# EasyEDA Pro project hardware.eprj, schematic Schematic5
Create Date: 2022-12-18; Page Name: P1; Project Name: hardware; Schematic Name: Schematic5; Update Date: 2022-12-24; Company: 嘉立创EDA; Page Size: A4; Version: V1.0
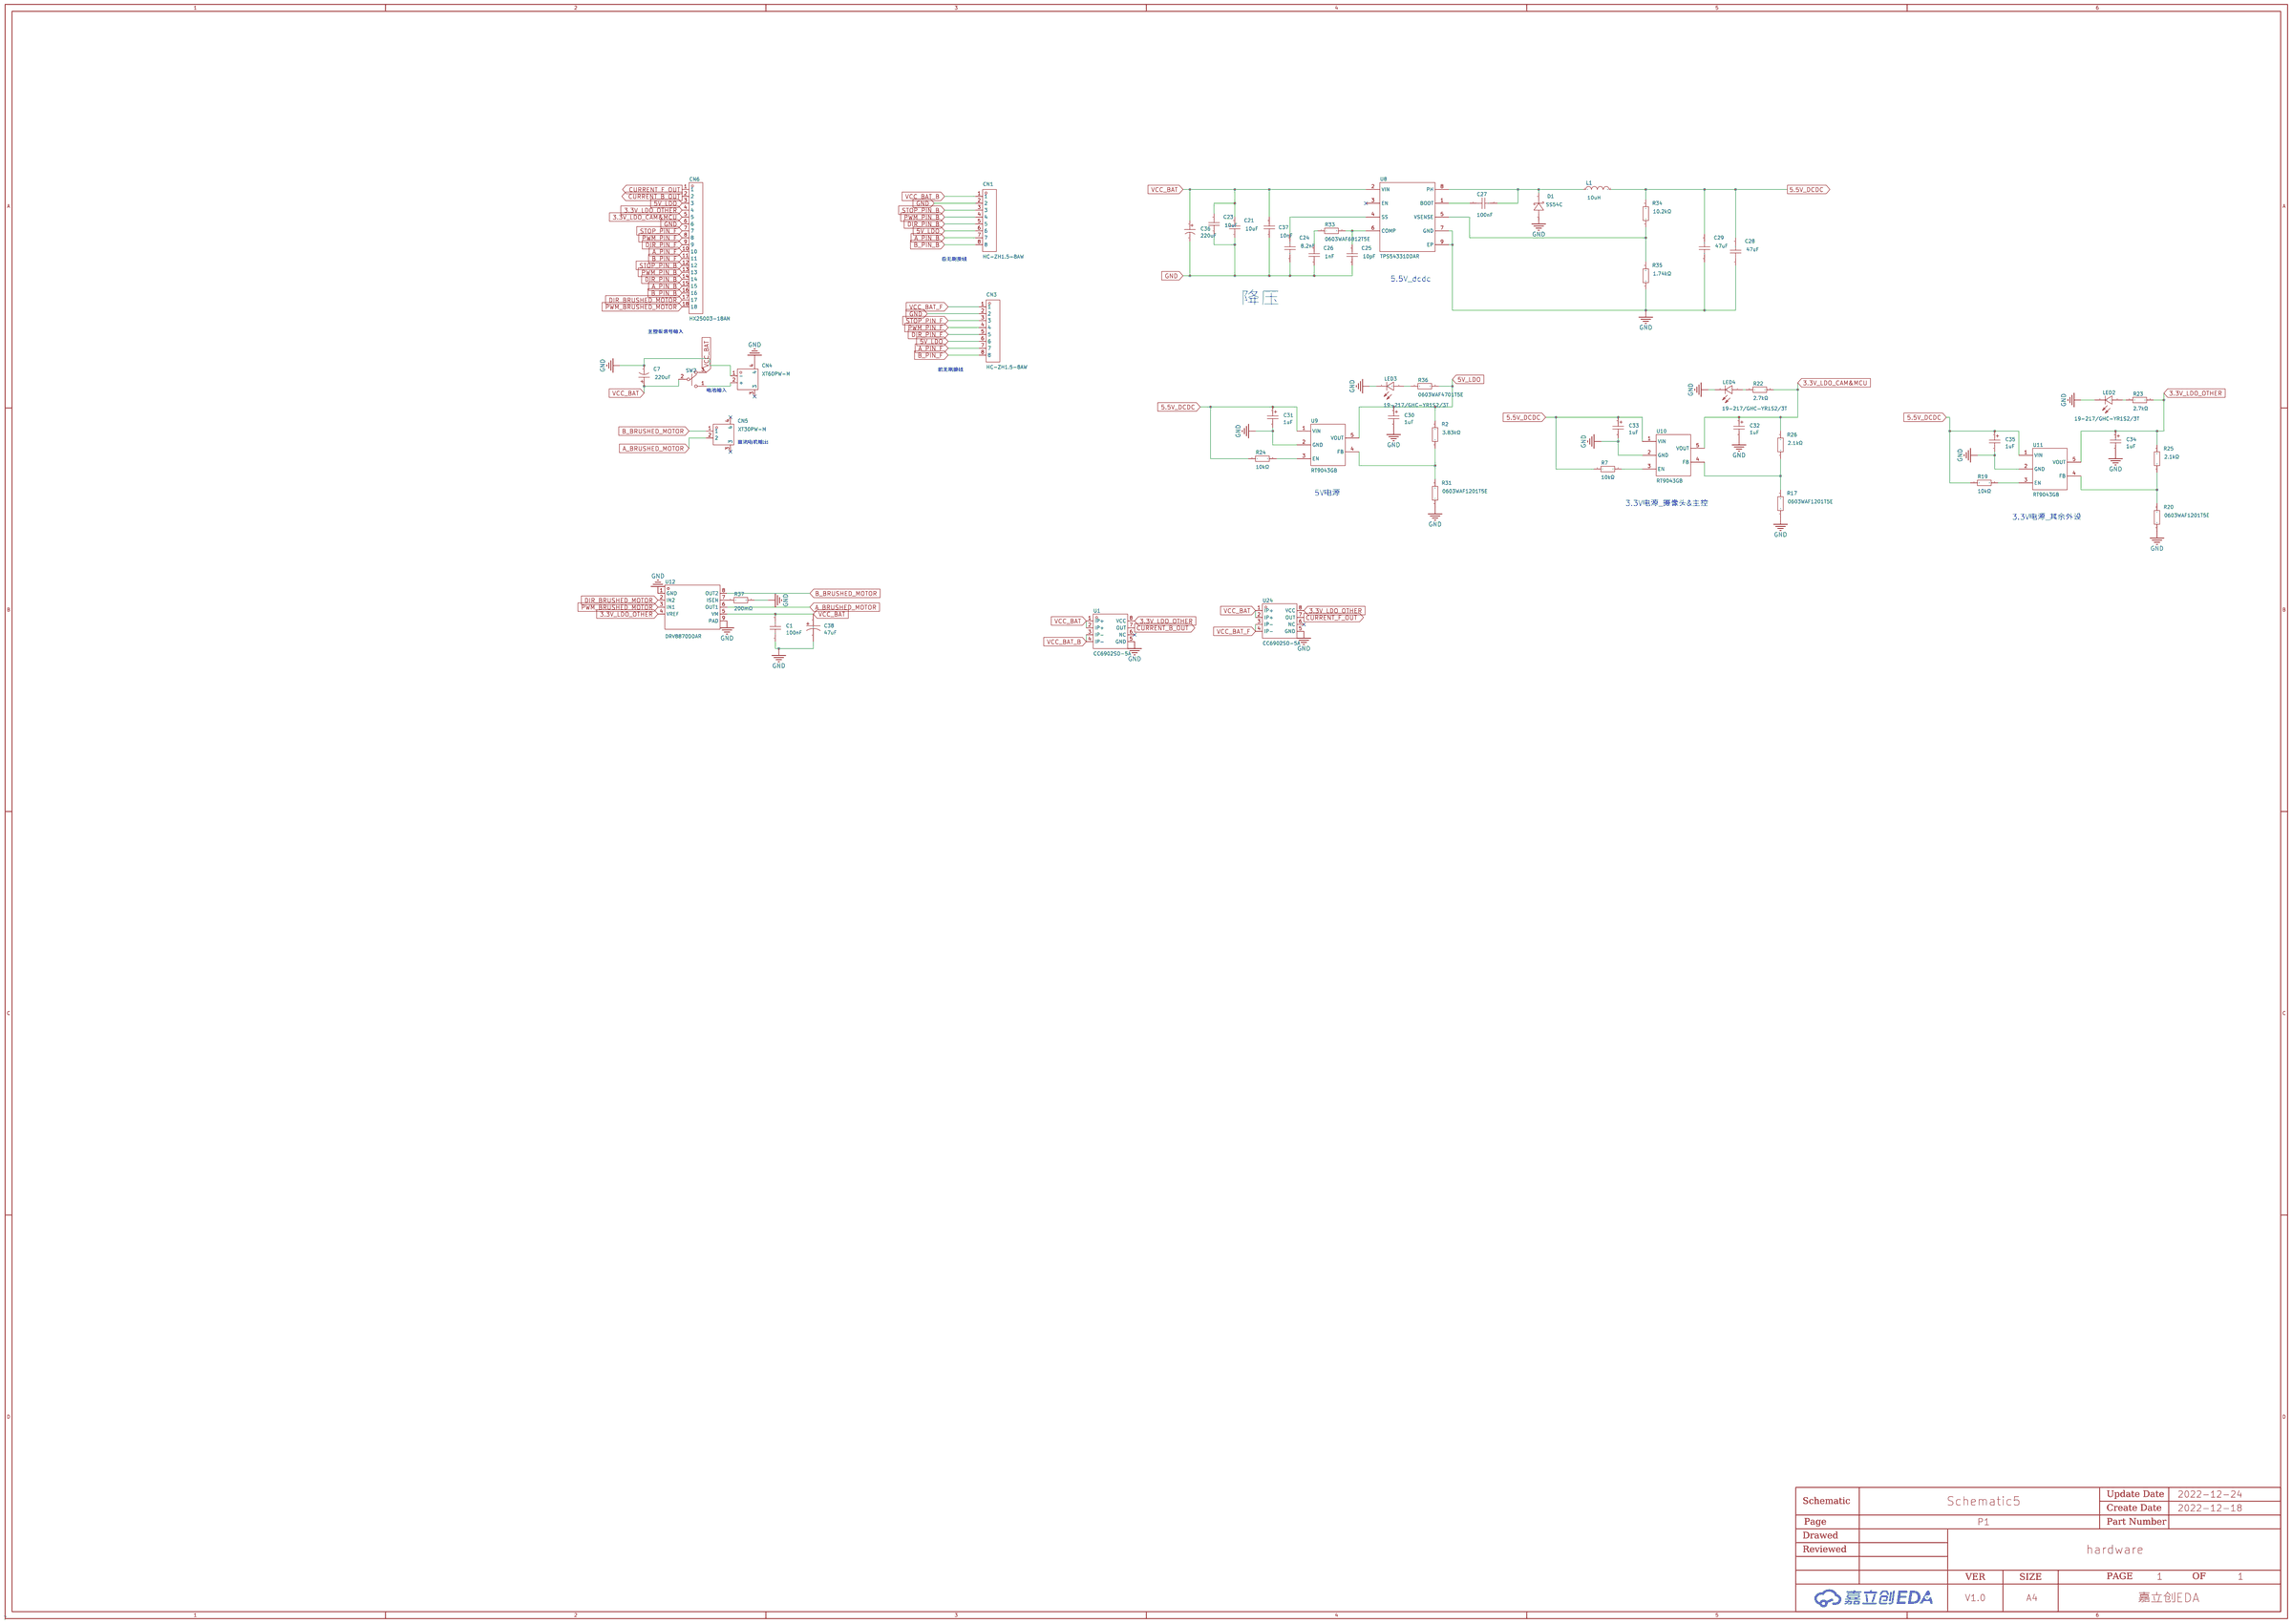
[diagram p5: schematic sheet]

## Parts
C1  100nF  [C0603]
C7  220uF  [CAP-TH_BD10.0-P5.00-D1.0-FD]
C21  10uF  [C1206]
C23  10uF  [C1206]
C24  8.2nF  [C0603]
C25  10pF  [C0402]
C26  1nF  [C0603]
C27  100nF  [C0603]
C28  47uF  [C1206]
C29  47uF  [C1206]
C30  1uF  [CAP-SMD_L3.2-W1.6-RD]
C31  1uF  [CAP-SMD_L3.2-W1.6-RD]
C32  1uF  [CAP-SMD_L3.2-W1.6-RD]
C33  1uF  [CAP-SMD_L3.2-W1.6-RD]
C34  1uF  [CAP-SMD_L3.2-W1.6-RD]
C35  1uF  [CAP-SMD_L3.2-W1.6-RD]
C36  220uF  [CAP-TH_BD10.0-P5.00-D1.0-FD]
C37  10nF  [C0603]
C38  47uF  [CAP-TH_BD6.3-P2.50-D1.0-FD]
CN1  HC-ZH1.5-8AW  [CONN-TH_8P-P1.50_HCTL_HC-ZH1.5-8AW]
CN3  HC-ZH1.5-8AW  [CONN-TH_8P-P1.50_HCTL_HC-ZH1.5-8AW]
CN4  XT60PW-M  [CONN-TH_XT60PW-M]
CN5  XT30PW-M  [CONN-TH_XT30PW-M]
CN6  HX25003-18AN  [CONN-TH_HX25003-18AN]
D1  SS54C  [SMC_L6.9-W5.9-LS7.9-R-RD]
L1  10uH  [IND-SMD_L11.5-W10.0_SMMS1040]
LED2  19-217/GHC-YR1S2/3T  [LED0603-R-RD]
LED3  19-217/GHC-YR1S2/3T  [LED0603-R-RD]
LED4  19-217/GHC-YR1S2/3T  [LED0603-R-RD]
R2  3.83kΩ  [R0603]
R7  10kΩ  [R0603]
R17  0603WAF1201T5E  [R0603]
R19  10kΩ  [R0603]
R20  0603WAF1201T5E  [R0603]
R22  2.7kΩ  [R0603]
R23  2.7kΩ  [R0603]
R24  10kΩ  [R0603]
R25  2.1kΩ  [R0603]
R26  2.1kΩ  [R0603]
R31  0603WAF1201T5E  [R0603]
R33  0603WAF6812T5E  [R0603]
R34  10.2kΩ  [R0603]
R35  1.74kΩ  [R0603]
R36  0603WAF4701T5E  [R0603]
R37  200mΩ  [R2512]
SW2  MT-0-103-A101-M200-RS+PJ  [SW-TH_MT-0-103-A101-M200-RS]
U1  CC6902SO-5A  [SOP-8_L4.9-W3.9-P1.27-LS6.0-BL]
U8  TPS54331DDAR  [SOIC-8_L5.0-W4.0-P1.27-LS6.0-BL-EP2.0]
U9  RT9043GB  [SOT-23-5_L3.0-W1.7-P0.95-LS2.8-BR]
U10  RT9043GB  [SOT-23-5_L3.0-W1.7-P0.95-LS2.8-BR]
U11  RT9043GB  [SOT-23-5_L3.0-W1.7-P0.95-LS2.8-BR]
U12  DRV8870DDAR  [HSOP-8_L5.0-W4.0-P1.27-LS6.2-BL-EP]
U24  CC6902SO-5A  [SOP-8_L4.9-W3.9-P1.27-LS6.0-BL]

## Library data of the parts
C1 C27 = CC0603KRX7R9BB104: 容值:100nF;精度:±10%;额定电压:50V;材质(温度系数):X7R;; LCSC Part Name: 100nF ±10% 50V; Supplier Part: C14663; Manufacturer: YAGEO(国巨); Supplier Footprint: 0603; JLCPCB Part Class: Basic Part; Datasheet: https://atta.szlcsc.com/upload/public/pdf/source/20170116/1484561234239.pdf; Supplier: LCSC; Tolerance: ±10%; Voltage Rated: 50V; Temperature Coefficient: X7R
C7 C36 = KM227M050G13RR0VH2FP0: 容值:220uF;脚间距:5mm;纹波电流:-;额定电压:50V;等效串联电阻:-;精度:±20%;工作寿命:2000hrs 105;电容体直径:10mm;工作温度:-;电容体长度:13mm;; LCSC Part Name: 220uF 50V; Supplier Part: C45105; Manufacturer: CX(承兴); Supplier Footprint: 径向引线,10x13mm; JLCPCB Part Class: Extended Part; Datasheet: https://atta.szlcsc.com/upload/public/pdf/source/20151029/1457707529682.pdf; Supplier: LCSC; Lead Spacing: 5mm; Rated Voltage: 50V; Tolerance: ±20%; Lifetime @ Temp: 2000hrs 105; φD: 10mm; L: 13mm
C21 C23 = CL31A106KBHNNNE: 容值:10uF;精度:±10%;额定电压:50V;材质(温度系数):X5R;; LCSC Part Name: 10uF ±10% 50V; Supplier Part: C13585; Manufacturer: SAMSUNG(三星); Supplier Footprint: 1206; JLCPCB Part Class: Basic Part; Datasheet: https://atta.szlcsc.com/upload/public/pdf/source/20160103/1457707668742.pdf; Supplier: LCSC; Tolerance: ±10%; Voltage Rated: 50V; Temperature Coefficient: X5R
C24 = CC0603KRX7R9BB822: 容值:8.2nF;精度:±10%;额定电压:50V;材质(温度系数):X7R;; LCSC Part Name: 8.2nF ±10% 50V; Supplier Part: C113812; Manufacturer: YAGEO(国巨); Supplier Footprint: 0603; JLCPCB Part Class: Extended Part; Datasheet: https://atta.szlcsc.com/upload/public/pdf/source/20170602/1496384445452.pdf; Supplier: LCSC; Tolerance: ±10%; Voltage Rated: 50V; Temperature Coefficient: X7R
C25 = CC0402JRNPO9BN100: 容值:10pF;精度:±5%;额定电压:50V;材质(温度系数):NP0;; LCSC Part Name: 10pF ±5% 50V; Supplier Part: C106199; Manufacturer: YAGEO(国巨); Supplier Footprint: 0402; JLCPCB Part Class: Extended Part; Datasheet: https://atta.szlcsc.com/upload/public/pdf/source/20170518/1495085708228.pdf; Supplier: LCSC; Tolerance: ±5%; Voltage Rated: 50V; Temperature Coefficient: NP0
C26 = CC0603KRX7R9BB102: 容值:1nF;精度:±10%;额定电压:50V;材质(温度系数):X7R;; LCSC Part Name: 1nF ±10% 50V; Supplier Part: C100040; Manufacturer: YAGEO(国巨); Supplier Footprint: 0603; JLCPCB Part Class: Extended Part; Datasheet: https://atta.szlcsc.com/upload/public/pdf/source/20170420/1492670664651.pdf; Supplier: LCSC; Tolerance: ±10%; Voltage Rated: 50V; Temperature Coefficient: X7R
C28 C29 = GRM31CR61A476ME15L: 容值:47uF;精度:±20%;额定电压:10V;温度系数:X5R;; LCSC Part Name: 47uF 10V; Supplier Part: C94034; Manufacturer: muRata(村田); Supplier Footprint: 1206; JLCPCB Part Class: Extended Part; Datasheet: https://atta.szlcsc.com/upload/public/pdf/source/20170310/1489116302849.pdf; Supplier: LCSC; Tolerance: ±20%; Voltage Rated: 10V; Temperature Coefficient: X5R
C30-C35 = TAJA105K016RNJ: 容值:1uF;精度:±10%;额定电压:16V;等效串联电阻:-;工作温度:-55~+125;; LCSC Part Name: 1uF ±10% 16V; Supplier Part: C7174; Manufacturer: Kyocera AVX; Supplier Footprint: CASE-A_3216; JLCPCB Part Class: Extended Part; Datasheet: https://atta.szlcsc.com/upload/public/pdf/source/20160107/1457707748219.pdf; Supplier: LCSC; Tolerance: ±10%; Rated Voltage: 16V; Operating Temperature: -55~+125
C37 = CC0603KRX7R9BB103: 容值:10nF;精度:±10%;额定电压:50V;材质(温度系数):X7R;; LCSC Part Name: 10nF ±10% 50V; Supplier Part: C100042; Manufacturer: YAGEO(国巨); Supplier Footprint: 0603; JLCPCB Part Class: Extended Part; Datasheet: https://atta.szlcsc.com/upload/public/pdf/source/20180326/C100042_E8B0111D51DE3671A0A4A59FBCEFE81C.pdf; Supplier: LCSC; Tolerance: ±10%; Voltage Rated: 50V; Temperature Coefficient: X7R
C38 = 50YXF47MEFC6.3X11: 容值:47uF;精度:±20%;额定电压:50V;电容体直径:6.3mm;电容体长度:11mm;脚间距:2.5mm;工作寿命:5000hrs@105℃;; LCSC Part Name: 47uF ±20% 50V; Supplier Part: C107641; Manufacturer: rubycon(红宝石); Supplier Footprint: 直插,D6.3xL11mm; JLCPCB Part Class: Extended Part; Datasheet: https://atta.szlcsc.com/upload/public/pdf/source/20180326/C107641_6B1BED4D7C5E3AE02FFDBEDD7186D0A1.pdf; Supplier: LCSC; Tolerance: ±20%; Rated Voltage: 50V; φD: 6.3mm; L: 11mm; Lead Spacing: 2.5mm; Lifetime @ Temp: 5000hrs@105℃
CN1 CN3 = HC-ZH1.5-8AW: 参考系列:ZH;间距:1.5mm;插针结构:1x8P;排数:1;每排PIN数:8;行距:-;公母:公型插针;安装方式:弯插;额定电流:1A;工作温度范围:-25~+85;; LCSC Part Name: 8P 间距P=1.5mm; Supplier Part: C2845571; Manufacturer: HCTL(华灿天禄); Supplier Footprint: 插件,P=1.5mm; JLCPCB Part Class: Extended Part; Datasheet: https://atta.szlcsc.com/upload/public/pdf/source/20211122/624702E7E83328BF37B6C704FA01E49F.pdf; Supplier: LCSC; Reference Series: ZH; Pitch: 1.5mm; Pins Structure: 1x8P; Number of Rows: 1; Number of PINs Per Row: 8; Gender: 公型插针; Mounting Style: 弯插; Current Rating (Max): 1A; Operating Temperature Range: -25~+85
CN4 = XT60PW-M: 模型锂电连接器; LCSC Part Name: XT60PW 公头 板插卧式; Supplier Part: C98732; Manufacturer: AMASS(艾迈斯); Supplier Footprint: Through Hole; JLCPCB Part Class: Extended Part; Datasheet: https://atta.szlcsc.com/upload/public/pdf/source/20180125/C98732_15168617837851301983.pdf; Supplier: LCSC
CN5 = XT30PW-M: Socket,DCsupply,XT30,male,PIN:2; LCSC Part Name: XT30PW-M公头; Supplier Part: C431092; Manufacturer: AMASS(艾迈斯); Supplier Footprint: Through Hole; JLCPCB Part Class: Extended Part; Datasheet: https://atta.szlcsc.com/upload/public/pdf/source/20220222/6A9F22F7850E25B33E1BE430ADF8560B.pdf; Supplier: LCSC
CN6 = HX25003-18AN: 参考系列:XH;间距:2.5mm;插针结构:1x18P;排数:1;每排PIN数:18;行距:-;公母:公型插针;安装方式:直插;额定电流:-;工作温度范围:-;; LCSC Part Name: 母座 直插/直针 2.5mm 18Pin位 母座; Supplier Part: C442314; Manufacturer: HX(红星); Supplier Footprint: 插件,P=2.5mm; JLCPCB Part Class: Extended Part; Datasheet: https://atta.szlcsc.com/upload/public/pdf/source/20191108/C442314_0D29571611B2DC08DC6409FA8A3BBCFD.pdf; Supplier: LCSC; Reference Series: XH; Pitch: 2.5mm; Pins Structure: 1x18P; Number of Rows: 1; Number of PINs Per Row: 18; Gender: 公型插针; Mounting Style: 直插
D1 = SS54C_C908244: 二极管配置:独立式;直流反向耐压(Vr):40V;平均整流电流(Io):5A;正向压降(Vf):550mV@5A;反向电流(Ir):500uA@40V;; LCSC Part Name: 40V 5A 550mV@5A; Supplier Part: C908244; Manufacturer: FUXINSEMI(富芯森美); Supplier Footprint: SMC(DO-214AB); JLCPCB Part Class: Extended Part; Datasheet: https://atta.szlcsc.com/upload/public/pdf/source/20201027/C908242_77C8A81B3EBE52B4332ED1F80CC85D97.pdf; Supplier: LCSC; Diode Configuration: 独立式; Reverse Voltage (Vr): 40V; Average Rectified Current (Io): 5A; Forward Voltage (Vf@If): 550mV@5A; Reverse Leakage Current (Ir): 500uA@40V
L1 = MWSA1004S-100MT: 精度:±20%;直流电阻(DCR):30mΩ;额定电流:7.8A;电感值:10uH;; LCSC Part Name: 10uH ±20%; Supplier Part: C408487; Manufacturer: Sunlord(顺络); Supplier Footprint: SMD; JLCPCB Part Class: Extended Part; Datasheet: https://atta.szlcsc.com/upload/public/pdf/source/20190729/C408487_10B27C975B2F63C7424A4B34DD502902.pdf; Supplier: LCSC; Tolerance: ±20%; DC Resistance (DCR): 30mΩ; Height: 4mm; Rated Current: 7.8A; Width: 11.5mm; Length: 10mm
LED2-LED4 = 19-217/GHC-YR1S2/3T: 照明颜色:翠绿;色温 - CCT（K）:-;主波长/色坐标:520~535nm;; LCSC Part Name: 翠绿LED; Supplier Part: C72043; Manufacturer: EVERLIGHT(台湾亿光); Supplier Footprint: 0603; JLCPCB Part Class: Basic Part; Datasheet: https://atta.szlcsc.com/upload/public/pdf/source/20160507/1462613613780.pdf; Supplier: LCSC; Mounting Type: 表面贴装; Illumination Color: 翠绿; Luminous Intensity (IF=20mA): 112~258mcd; Dominant Wavelength / Coordinate rank: 520~535nm
R2 = 0603WAF3831T5E: 精度:±1%;温度系数:±100ppm/;功率:1/10W;阻值:3.83kΩ;最大工作电压:75V;工作温度范围:-55~+155;; LCSC Part Name: 3.83KΩ ±1%; Supplier Part: C22982; Manufacturer: UNI-ROYAL(厚声); Supplier Footprint: 0603; JLCPCB Part Class: Extended Part; Datasheet: https://atta.szlcsc.com/upload/public/pdf/source/20170920/C22982_1505901016435982369.pdf; Supplier: LCSC; Tolerance: ±1%; Temperature Coefficient: ±100ppm/; Power(Watts): 1/10W; Overload Voltage (Max): 75V; Operating Temperature Range: -55~+155
R7 R19 R24 = 0603WAF1002T5E: 电阻类型:厚膜电阻;阻值:10kΩ;精度:±1%;功率:100mW;温度系数:±100ppm/;最大工作电压:75V;工作温度范围:-55~+155;; LCSC Part Name: 10kΩ ±1% 100mW; Supplier Part: C25804; Manufacturer: UNI-ROYAL(厚声); Supplier Footprint: 0603; JLCPCB Part Class: Basic Part; Datasheet: https://atta.szlcsc.com/upload/public/pdf/source/20200306/C422600_1E6D84923E4A46A82E41ADD87F860B5C.pdf; Supplier: LCSC; Type: 厚膜电阻; Tolerance: ±1%; Power(Watts): 100mW; Temperature Coefficient: ±100ppm/; Overload Voltage (Max): 75V; Operating Temperature Range: -55~+155
R17 R20 R31 = 0603WAF1201T5E: LCSC Part Name: 1.2KΩ(1201) ±1% 编带; Supplier Part: C22765; Manufacturer: UNI-ROYAL(厚声); Supplier Footprint: 0603; JLCPCB Part Class: Basic Part; Datasheet: https://atta.szlcsc.com/upload/public/pdf/source/20170920/C22765_1505887453653980563.pdf; Supplier: LCSC
R22 R23 = 0603WAF2701T5E: 电阻类型:厚膜电阻;阻值:2.7kΩ;精度:±1%;功率:100mW;温度系数:±100ppm/;最大工作电压:75V;工作温度范围:-55~+155;; LCSC Part Name: 2.7kΩ ±1% 100mW; Supplier Part: C13167; Manufacturer: UNI-ROYAL(厚声); Supplier Footprint: 0603; JLCPCB Part Class: Basic Part; Datasheet: https://atta.szlcsc.com/upload/public/pdf/source/20200306/C422600_1E6D84923E4A46A82E41ADD87F860B5C.pdf; Supplier: LCSC; Type: 厚膜电阻; Tolerance: ±1%; Power(Watts): 100mW; Temperature Coefficient: ±100ppm/; Overload Voltage (Max): 75V; Operating Temperature Range: -55~+155
R25 R26 = 0603WAF2101T5E: 电阻类型:厚膜电阻;阻值:2.1kΩ;精度:±1%;功率:100mW;温度系数:±100ppm/;最大工作电压:75V;工作温度范围:-55~+155;; LCSC Part Name: 2.1kΩ ±1% 100mW; Supplier Part: C22902; Manufacturer: UNI-ROYAL(厚声); Supplier Footprint: 0603; JLCPCB Part Class: Extended Part; Datasheet: https://atta.szlcsc.com/upload/public/pdf/source/20200306/C422600_1E6D84923E4A46A82E41ADD87F860B5C.pdf; Supplier: LCSC; Type: 厚膜电阻; Tolerance: ±1%; Power(Watts): 100mW; Temperature Coefficient: ±100ppm/; Overload Voltage (Max): 75V; Operating Temperature Range: -55~+155
R33 = 0603WAF6812T5E: LCSC Part Name: 68.1KΩ(6812) ±1% 编带; Supplier Part: C25976; Manufacturer: UNI-ROYAL(厚声); Supplier Footprint: 0603; JLCPCB Part Class: Extended Part; Datasheet: https://atta.szlcsc.com/upload/public/pdf/source/20170920/C25976_1505895134985980970.pdf; Supplier: LCSC
R34 = 0603WAF1022T5E: 电阻类型:厚膜电阻;阻值:10.2kΩ;精度:±1%;功率:100mW;温度系数:±100ppm/;最大工作电压:75V;工作温度范围:-55~+155;; LCSC Part Name: 10.2kΩ ±1% 100mW; Supplier Part: C22772; Manufacturer: UNI-ROYAL(厚声); Supplier Footprint: 0603; JLCPCB Part Class: Extended Part; Datasheet: https://atta.szlcsc.com/upload/public/pdf/source/20200306/C422600_1E6D84923E4A46A82E41ADD87F860B5C.pdf; Supplier: LCSC; Type: 厚膜电阻; Tolerance: ±1%; Power(Watts): 100mW; Temperature Coefficient: ±100ppm/; Overload Voltage (Max): 75V; Operating Temperature Range: -55~+155
R35 = 0603WAF1741T5E: 电阻类型:厚膜电阻;阻值:1.74kΩ;精度:±1%;功率:1/10W;温度系数:±100ppm/;最大工作电压:75V;工作温度范围:-55~+155;; LCSC Part Name: 1.74kΩ ±1%; Supplier Part: C22848; Manufacturer: UNI-ROYAL(厚声); Supplier Footprint: 0603; JLCPCB Part Class: Extended Part; Datasheet: https://atta.szlcsc.com/upload/public/pdf/source/20200306/C422600_1E6D84923E4A46A82E41ADD87F860B5C.pdf; Supplier: LCSC; Type: 厚膜电阻; Tolerance: ±1%; Power(Watts): 1/10W; Temperature Coefficient: ±100ppm/; Overload Voltage (Max): 75V; Operating Temperature Range: -55~+155
R36 = 0603WAF4701T5E: LCSC Part Name: 4.7KΩ(4701) ±1% 编带; Supplier Part: C23162; Manufacturer: UNI-ROYAL(厚声); Supplier Footprint: 0603; JLCPCB Part Class: Basic Part; Datasheet: https://atta.szlcsc.com/upload/public/pdf/source/20170920/C23162_1505901109673982545.pdf; Supplier: LCSC
R37 = 25121WF200LT4E: 电阻类型:厚膜电阻;阻值:200mΩ;精度:±1%;功率:1W;温度系数:±800ppm/℃;最大工作电压:200V;工作温度范围:-55℃~+155℃;; LCSC Part Name: 200mΩ ±1% 1W; Supplier Part: C83749; Manufacturer: UNI-ROYAL(厚声); Supplier Footprint: 2512; JLCPCB Part Class: Extended Part; Datasheet: https://atta.szlcsc.com/upload/public/pdf/source/20200306/C422600_1E6D84923E4A46A82E41ADD87F860B5C.pdf; Supplier: LCSC; Type: 厚膜电阻; Tolerance: ±1%; Power(Watts): 1W; Temperature Coefficient: ±800ppm/℃; Overload Voltage (Max): 200V; Operating Temperature Range: -55℃~+155℃
SW2 = MT-0-103-A101-M200-RS+PJ: 额定电流:5A;额定电压(AC):125V;电路结构:单刀双掷;钮柄形状:圆柱钮柄;引脚样式:焊片;安装方式:直插;工作温度:-25~+85;开关长度:13mm;开关宽度:8mm;开关高度:28.6mm;; LCSC Part Name: 小型钮子三脚三档(五件套); Supplier Part: C1788493; Manufacturer: YUEN FUNG(源丰); Supplier Footprint: 插件; JLCPCB Part Class: Extended Part; Datasheet: https://atta.szlcsc.com/upload/public/pdf/source/20201225/C1788493_608759AD4D4A20FF90A03E3E3321FD91.pdf; Supplier: LCSC; Contact Current: 5A; Voltage Rating (AC): 125V; Circuit: 单刀双掷; Actuator Type: 圆柱钮柄; Pin Style: 焊片; Mounting Style: 直插; Operating Temperature: -25~+85; Switch Length: 13mm; Switch Width: 8mm; Switch Height: 28.6mm
U1 U24 = CC6902SO-5A: 单芯片霍尔电流传感器5A/10A/20A/30A系列,隔离耐压2kV,增益400mV/A; Supplier Part: C465515; Manufacturer: CrossChip(成都芯进); Supplier Footprint: SOP-8-150mil; JLCPCB Part Class: Extended Part; Datasheet: https://atta.szlcsc.com/upload/public/pdf/source/20210401/C350865_A3325EEAFF04FA6E122338C4D9E855FE.pdf; Supplier: LCSC
U8 = TPS54331DDAR: 功能类型:降压型;同步整流:-;输出通道数:-;拓扑结构:-;输入电压:-;输出电流(最大值):-;开关频率:-;; LCSC Part Name: 降压型; Supplier Part: C90761; Manufacturer: TI(德州仪器); Supplier Footprint: SOIC-8-EP-150mil; JLCPCB Part Class: Extended Part; Datasheet: https://atta.szlcsc.com/upload/public/pdf/source/20171221/C90761_15138313277351195613.pdf; Supplier: LCSC; Function: 降压型
U9-U11 = RT9043GB: 输出类型:可调;输出极性:正;输出通道数:1;最大输入电压:5.5V;输出电压:1.2V~5V;压差:350mV@(400mA);输出电流:400mA;电源纹波抑制比(PRSS):67dB@(1kHz),56dB@(10kHz);; LCSC Part Name: Vin=5.5V Vout=1.2V~5V 400mA 67dB@(1kHz),56dB@(10kHz); Supplier Part: C55019; Manufacturer: RICHTEK(台湾立锜); Supplier Footprint: SOT-23-5; JLCPCB Part Class: Extended Part; Datasheet: https://atta.szlcsc.com/upload/public/pdf/source/20150811/1457707342352.pdf; Supplier: LCSC; Output Type: 可调; Output Polarity: 正; Number of Outputs: 1; Maximum Input Voltage: 5.5V; Output Voltage: 1.2V~5V; Dropout Voltage: 350mV@(400mA); Output Current: 400mA; Power Supply Rejection Ratio (PRSS): 67dB@(1kHz),56dB@(10kHz)
U12 = DRV8870DDAR: Supplier Part: C86590; Manufacturer: TI(德州仪器); Supplier Footprint: HSOP-8-EP-4.0mm; JLCPCB Part Class: Extended Part; Datasheet: https://atta.szlcsc.com/upload/public/pdf/source/20170908/C86590_1504870130414958090.pdf; Supplier: LCSC

## Nets
3.3V_LDO_CAM&MCU: C32.1 CN6.5 R22.2 R26.2 U10.5(VOUT)
3.3V_LDO_OTHER: C34.1 CN6.4 R23.2 R25.2 U1.8(VCC) U11.5(VOUT) U12.4(VREF) U24.8(VCC)
5.5V_DCDC: C28.2 C29.2 C31.1 C33.1 C35.1 L1.2 R7.1 R19.1 R24.1 R34.2 U9.1(VIN) U10.1(VIN) U11.1(VIN)
5V_LDO: C30.1 CN1.6 CN3.6 CN6.3 R2.2 R36.2 U9.5(VOUT)
GND: C1.1 C7.2 C21.1 C23.1 C24.1 C25.1 C26.1 C28.1 C29.1 C30.2 C31.2 C32.2 C33.2 C34.2 C35.2 C36.2 C37.1 C38.2 CN1.2 CN3.2 CN4.1(-) CN4.4 CN6.6 D1.1(A) LED2.2(C) LED3.2(C) LED4.2(C) R17.1 R20.1 R31.1 R35.1 R37.2 U1.5(GND) U8.7(GND) U8.9(EP) U9.2(GND) U10.2(GND) U11.2(GND) U12.1(GND) U12.9(PAD) U24.5(GND)
VCC_BAT: C1.2 C7.1 C21.2 C23.2 C36.1 C37.2 C38.1 SW2.2 SW2.3 U1.1(IP+) U1.2(IP+) U8.2(VIN) U12.5(VM) U24.1(IP+) U24.2(IP+)
VCC_BAT_B: CN1.1 U1.3(IP-) U1.4(IP-)
VCC_BAT_F: CN3.1 U24.3(IP-) U24.4(IP-)
A_BRUSHED_MOTOR: CN5.2 U12.6(OUT1)
A_PIN_B: CN1.7 CN6.15
A_PIN_F: CN3.7 CN6.10
B_BRUSHED_MOTOR: CN5.1 U12.8(OUT2)
B_PIN_B: CN1.8 CN6.16
B_PIN_F: CN3.8 CN6.11
CURRENT_B_OUT: CN6.2 U1.7(OUT)
CURRENT_F_OUT: CN6.1 U24.7(OUT)
DIR_BRUSHED_MOTOR: CN6.17 U12.2(IN2)
DIR_PIN_B: CN1.5 CN6.14
DIR_PIN_F: CN3.5 CN6.9
PWM_BRUSHED_MOTOR: CN6.18 U12.3(IN1)
PWM_PIN_B: CN1.4 CN6.13
PWM_PIN_F: CN3.4 CN6.8
STOP_PIN_B: CN1.3 CN6.12
STOP_PIN_F: CN3.3 CN6.7
$1N4925: CN4.2(+) SW2.1
$1N11448: C24.2 U8.4(SS)
$1N11449: C25.2 R33.2 U8.6(COMP)
$1N11450: C26.2 R33.1
$1N11452: R34.1 R35.2 U8.5(VSENSE)
$1N11457: R24.2 U9.3(EN)
$1N11458: R2.1 R31.2 U9.4(FB)
$1N11461: R7.2 U10.3(EN)
$1N11462: R17.2 R26.1 U10.4(FB)
$1N11464: R20.2 R25.1 U11.4(FB)
$1N11465: R19.2 U11.3(EN)
$1N11482: LED3.1(A) R36.1
$1N11484: LED4.1(A) R22.1
$1N11486: LED2.1(A) R23.1
$1N11492: C27.2 D1.2(K) L1.1 U8.8(PH)
$1N11493: C27.1 U8.1(BOOT)
$1N43086: R37.1 U12.7(ISEN)

Not connected (* = marked no-connect by the designer): CN4 3*; CN5 3* 4*; U1 6(NC)*; U8 3(EN)*; U24 6(NC)*

## Notes on the sheet
- 后无刷接线
- 5.5V_dcdc
- 降压
- 主控板信号输入
- 前无刷接线
- 电池输入
- 直流电机输出
- 5V电源
- 3.3V电源_摄像头＆主控
- 3.3V电源_其余外设
